# Altium schematic sheet SysUprTestUUUp.SchDoc (part 1 of 2) (continued)
## Parts (continued)
FU13  Predoxranitel  [MF-MSMF_1]  (value not drawn)
FU14  Predoxranitel  [MF-MSMF_1]  (value not drawn)
FU15  Predoxranitel  [MF-MSMF_1]  (value not drawn)
FU16  Predoxranitel  [MF-MSMF_1]  (value not drawn)
FU17  Predoxranitel  [MF-MSMF_1]  (value not drawn)
FU18  Predoxranitel  [MF-MSMF_1]  (value not drawn)
FU19  Predoxranitel  [MF-MSMF_1]  (value not drawn)
FU20  Predoxranitel  [MF-MSMF_1]  (value not drawn)
FU21  Predoxranitel  [MF-MSMF_1]  (value not drawn)
HL1  LED-RGB_C  [BL-L515]  (value not drawn)
KT1  Kont  [TESTPOINT]  (value not drawn)  (no BOM)
KT2  Kont  [TESTPOINT]  (value not drawn)  (no BOM)
KT3  Kont  [TESTPOINT]  (value not drawn)  (no BOM)
KT4  Kont  [TESTPOINT]  (value not drawn)  (no BOM)
KT5  Kont  [TESTPOINT]  (value not drawn)  (no BOM)
KT6  Kont  [TESTPOINT]  (value not drawn)  (no BOM)
KT7  Kont  [TESTPOINT]  (value not drawn)  (no BOM)
KT8  Kont  [TESTPOINT]  (value not drawn)  (no BOM)
KT9  Kont  [TESTPOINT]  (value not drawn)  (no BOM)
R1  value 1к  [Res0402]  (hidden comment: Resistor0062)
R2  value 1к  [Res0402]  (hidden comment: Resistor0062)
R3  value 1к  [Res0402]  (hidden comment: Resistor0062)
R4  value 1к  [Res0402]  (hidden comment: Resistor0062)
R5  value 1к  [Res0402]  (hidden comment: Resistor0062)
R6  value 1к  [Res0402]  (hidden comment: Resistor0062)
R7  value 10к  [Res0402]  (hidden comment: Resistor0062)
R8  value 10к  [Res0402]  (hidden comment: Resistor0062)
R9  value 10к  [Res0402]  (hidden comment: Resistor0062)
R10  value 10к  [Res0402]  (hidden comment: Resistor0062)
R11  value 10к  [Res0402]  (hidden comment: Resistor0062)
R12  value 10к  [Res0402]  (hidden comment: Resistor0062)
R13  value 10к  [Res0402]  (hidden comment: Resistor0062)
R14  value 10к  [Res0402]  (hidden comment: Resistor0062)
R15  value 10к  [Res0402]  (hidden comment: Resistor0062)
R16  value 10к  [Res0402]  (hidden comment: Resistor0062)
R17  value 10к  [Res0402]  (hidden comment: Resistor0062)
R18  value 10к  [Res0402]  (hidden comment: Resistor0062)
R19  value 10к  [Res0402]  (hidden comment: Resistor0062)
R20  value 100к  [Res0402]  (hidden comment: Resistor0062)
R21  value 100к  [Res0402]  (hidden comment: Resistor0062)
R22  value 1к  [Res0402]  (hidden comment: Resistor0062)
R23  value 1к  [Res0402]  (hidden comment: Resistor0062)
R24  value 1к  [Res0402]  (hidden comment: Resistor0062)
R25  value 1к  [Res0402]  (hidden comment: Resistor0062)
R26  value 1к  [Res0402]  (hidden comment: Resistor0062)
R27  value 1к  [Res0402]  (hidden comment: Resistor0062)
R28  value 10к  [Res0402]  (hidden comment: Resistor0062)
R29  value 10к  [Res0402]  (hidden comment: Resistor0062)
R30  value 100к  [Res0402]  (hidden comment: Resistor0062)
R31  value 100к  [Res0402]  (hidden comment: Resistor0062)
R32  value 100к  [Res0402]  (hidden comment: Resistor0062)
R33  value 100к  [Res0402]  (hidden comment: Resistor0062)
R34  value 100к  [Res0402]  (hidden comment: Resistor0062)
R35  value 100к  [Res0402]  (hidden comment: Resistor0062)
R36  value 100к  [Res0402]  (hidden comment: Resistor0062)
R37  value 100к  [Res0402]  (hidden comment: Resistor0062)
R38  value 1к  [Res0402]  (hidden comment: Resistor0062)
R39  value 1к  [Res0402]  (hidden comment: Resistor0062)
R40  value 1к  [Res0402]  (hidden comment: Resistor0062)
R41  value 100к  [Res0402]  (hidden comment: Resistor0062)
R42  value 100к  [Res0402]  (hidden comment: Resistor0062)
R43  value 100к  [Res0402]  (hidden comment: Resistor0062)
R44  value 100к  [Res0402]  (hidden comment: Resistor0062)
R45  value 100к  [Res0402]  (hidden comment: Resistor0062)
R46  value 100к  [Res0402]  (hidden comment: Resistor0062)
R47  value 100к  [Res0402]  (hidden comment: Resistor0062)
R48  value 100к  [Res0402]  (hidden comment: Resistor0062)
R49  value 10к  [Res0402]  (hidden comment: Resistor0062)
R50  value 10к  [Res0402]  (hidden comment: Resistor0062)
R51  value 100к  [Res0402]  (hidden comment: Resistor0062)
R52  value 100к  [Res0402]  (hidden comment: Resistor0062)
R53  value 100к  [Res0402]  (hidden comment: Resistor0062)
R54  value 100к  [Res0402]  (hidden comment: Resistor0062)
R55  value 100к  [Res0402]  (hidden comment: Resistor0062)
R56  value 100к  [Res0402]  (hidden comment: Resistor0062)
R57  value 100к  [Res0402]  (hidden comment: Resistor0062)
R58  value 100к  [Res0402]  (hidden comment: Resistor0062)
R59  value 120  [Res0805]  (hidden comment: Resistor0125)
R60  value 120  [Res0805]  (hidden comment: Resistor0125)
R61  value 120  [Res0805]  (hidden comment: Resistor0125)
R62  value 120  [Res0805]  (hidden comment: Resistor0125)
R63  value 120  [Res0805]  (hidden comment: Resistor0125)
R64  value 120  [Res0805]  (hidden comment: Resistor0125)
R65  value 120  [Res0805]  (hidden comment: Resistor0125)
R66  value 120  [Res0805]  (hidden comment: Resistor0125)
R67  value 10к  [Res0402]  (hidden comment: Resistor0062)
R68  value 10к  [Res0402]  (hidden comment: Resistor0062)
R69  value 10к  [Res0402]  (hidden comment: Resistor0062)
R70  value 10к  [Res0402]  (hidden comment: Resistor0062)
R71  value 10к  [Res0402]  (hidden comment: Resistor0062)
R72  value 10к  [Res0402]  (hidden comment: Resistor0062)
R73  value 10к  [Res0402]  (hidden comment: Resistor0062)
R74  value 10к  [Res0402]  (hidden comment: Resistor0062)
R75  value 10к  [Res0402]  (hidden comment: Resistor0062)
R76  value 10к  [Res0402]  (hidden comment: Resistor0062)
R77  value 10к  [Res0402]  (hidden comment: Resistor0062)
R78  value 10М  [Res0805]  (hidden comment: Resistor0125)
R79  value 10к  [Res0402]  (hidden comment: Resistor0062)
R80  value 10к  [Res0402]  (hidden comment: Resistor0062)
R81  value 10к  [Res0402]  (hidden comment: Resistor0062)
R82  value 10к  [Res0402]  (hidden comment: Resistor0062)
R83  value 10к  [Res0402]  (hidden comment: Resistor0062)
R84  value 10к  [Res0402]  (hidden comment: Resistor0062)
R85  value 10к  [Res0402]  (hidden comment: Resistor0062)
R86  value 10к  [Res0402]  (hidden comment: Resistor0062)
R87  value 10к  [Res0402]  (hidden comment: Resistor0062)
R88  value 10к  [Res0402]  (hidden comment: Resistor0062)
R89  value 10к  [Res0402]  (hidden comment: Resistor0062)
R90  value 10к  [Res0402]  (hidden comment: Resistor0062)
R91  value 10к  [Res0402]  (hidden comment: Resistor0062)
R92  value 6,8к  [Res0402]  (hidden comment: Resistor0062)
R93  value 6,8к  [Res0402]  (hidden comment: Resistor0062)
R94  value 1к  [Res0402]  (hidden comment: Resistor0062)
R95  value 3,3к  [Res0402]  (hidden comment: Resistor0062)
R96  value 3,3к  [Res0402]  (hidden comment: Resistor0062)
R97  value 10к  [Res0402]  (hidden comment: Resistor0062)
R98  value 10к  [Res0402]  (hidden comment: Resistor0062)
R99  value 1к  [Res0402]  (hidden comment: Resistor0062)
R100  value 1к  [Res0402]  (hidden comment: Resistor0062)
R101  value 10к  [Res0603]  (hidden comment: Resistor01)
R102  value 10к  [Res0402]  (hidden comment: Resistor0062)
R103  value 10к  [Res0402]  (hidden comment: Resistor0062)
R104  value 10к  [Res0402]  (hidden comment: Resistor0062)
R105  value 10к  [Res0402]  (hidden comment: Resistor0062)
R106  value 10к  [Res0402]  (hidden comment: Resistor0062)
R107  value 10к  [Res0402]  (hidden comment: Resistor0062)
R108  value 10к  [Res0402]  (hidden comment: Resistor0062)
R109  value 10к  [Res0402]  (hidden comment: Resistor0062)
R110  value 10к  [Res0402]  (hidden comment: Resistor0062)
R111  value 120  [Res0805]  (hidden comment: Resistor0125)
R112  value 120  [Res0805]  (hidden comment: Resistor0125)
R113  value 120  [Res0805]  (hidden comment: Resistor0125)
R114  value 120  [Res0805]  (hidden comment: Resistor0125)
R115  value 120  [Res0805]  (hidden comment: Resistor0125)
R116  value 120  [Res0805]  (hidden comment: Resistor0125)
R117  value 10к  [Res0402]  (hidden comment: Resistor0062)
R118  value 10к  [Res0402]  (hidden comment: Resistor0062)
R119  value 10к  [Res0402]  (hidden comment: Resistor0062)
R120  value 10к  [Res0402]  (hidden comment: Resistor0062)
R121  value 10к  [Res0402]  (hidden comment: Resistor0062)
R122  value 10к  [Res0402]  (hidden comment: Resistor0062)
R123  value 120  [Res0805]  (hidden comment: Resistor0125)
R124  value 10  [Res0603]  (hidden comment: Resistor01)
R125  value 120  [Res0805]  (hidden comment: Resistor0125)
R126  value 10  [Res0603]  (hidden comment: Resistor01)
R127  value 10  [Res0603]  (hidden comment: Resistor01)
R128  value 10  [Res0603]  (hidden comment: Resistor01)
R129  value 22  [Res0805]  (hidden comment: Resistor0125)
R130  value 22  [Res0805]  (hidden comment: Resistor0125)
R131  value 22  [Res0805]  (hidden comment: Resistor0125)
R132  value 22  [Res0805]  (hidden comment: Resistor0125)
R133  value 22  [Res0805]  (hidden comment: Resistor0125)
R134  value 22  [Res0805]  (hidden comment: Resistor0125)
R135  value 22  [Res0805]  (hidden comment: Resistor0125)
R136  value 22  [Res0805]  (hidden comment: Resistor0125)
R137  value 22  [Res0805]  (hidden comment: Resistor0125)
R138  value 22  [Res0805]  (hidden comment: Resistor0125)
R139  value 22  [Res0805]  (hidden comment: Resistor0125)
R140  value 22  [Res0805]  (hidden comment: Resistor0125)
R141  value 10к  [Res0402]  (hidden comment: Resistor0062)
R142  value 10к  [Res0402]  (hidden comment: Resistor0062)
R143  value 10к  [Res0402]  (hidden comment: Resistor0062)
R144  value 10к  [Res0402]  (hidden comment: Resistor0062)
R145  value 10к  [Res0402]  (hidden comment: Resistor0062)
R146  value 10к  [Res0402]  (hidden comment: Resistor0062)
VD1  Name: SMBJ5.0CA  [SMB_(DO-214AA) KA1-KA2]  (hidden comment: DiodZachitnuy)
VD2  Name: SMBJ5.0CA  [SMB_(DO-214AA) KA1-KA2]  (hidden comment: DiodZachitnuy)
VD3  Name: SMBJ5.0CA  [SMB_(DO-214AA) KA1-KA2]  (hidden comment: DiodZachitnuy)
VD4  Name: SMBJ5.0CA  [SMB_(DO-214AA) KA1-KA2]  (hidden comment: DiodZachitnuy)
VD5  Name: SMBJ5.0CA  [SMB_(DO-214AA) KA1-KA2]  (hidden comment: DiodZachitnuy)
VD6  Name: 2Д706АС9  [SOT23 2D706AS9]  (hidden comment: Diod2K)
VD7  DiodZachitnuy  [SMB_(DO-214AA) KA1-KA2]  (value not drawn)
VD8  DiodZachitnuy  [SMB_(DO-214AA) KA1-KA2]  (value not drawn)
VD9  DiodZachitnuy  [SMB_(DO-214AA) KA1-KA2]  (value not drawn)
VD10  DiodZachitnuy  [SMB_(DO-214AA) KA1-KA2]  (value not drawn)
VD11  DiodZachitnuy  [SMB_(DO-214AA) KA1-KA2]  (value not drawn)
VD12  DiodZachitnuy  [SMB_(DO-214AA) KA1-KA2]  (value not drawn)
VD13  Name: SMBJ5.0CA  [SMB_(DO-214AA) KA1-KA2]  (hidden comment: DiodZachitnuy)
VD14  Name: SMBJ5.0CA  [SMB_(DO-214AA) KA1-KA2]  (hidden comment: DiodZachitnuy)
VD15  Name: SMBJ5.0CA  [SMB_(DO-214AA) KA1-KA2]  (hidden comment: DiodZachitnuy)
VD16  Name: SMBJ5.0CA  [SMB_(DO-214AA) KA1-KA2]  (hidden comment: DiodZachitnuy)
XP1  ConnectorP34  [PLD-34]  (value not drawn)
XP2  ConnectorP10  [PLD-10]  (value not drawn)
XP3  ConnectorP4  [PLD-4]  (value not drawn)
XP4  ConnectorP8  [PLD-8]  (value not drawn)
XP5  ConnectorP2  [PLS-2]  (value not drawn)
XP6  ConnectorP2  [PLS-2]  (value not drawn)
XP7  ConnectorP8  [PLD-8]  (value not drawn)
XP8  ConnectorP2  [PLS-2]  (value not drawn)
XP9  ConnectorP3  [PLS-3]  (value not drawn)
XP10  ConnectorP4  [PLS-4]  (value not drawn)
XP11  ConnectorP40  [PLD-40R]  (value not drawn)
XP12  ConnectorP40  [PLD-40R]  (value not drawn)
XS1  ConnectorS40  [PBD-40]  (value not drawn)
XS2  ConnectorS40  [PBD-40]  (value not drawn)
ZQ1  value 8 МГц  [HC-49SM_U]  (hidden comment: Quartz)

## Nets
+3.3V_A: DD11.38(Vref+) DD11.39(Vdda) XS1.30 XS1.31
+3.3V_D: C1.2 C2.2 C4.2 C6.1 C7.2 C8.2 C15.2 C30.2 C31.2 C32.2 C39.2 C42.2 C43.2 C48.2 C55.2 C56.2 C57.2 C58.2 DA1.8(Vcc) DA2.8(Vcc) DA3.8(Vcc) DA4.8(Vcc) DA5.8(Vcc) DD11.15(Vdd) DD11.23(Vdd) DD11.36(Vdd) DD11.49(Vdd) DD11.62(Vdd) DD11.72(Vdd) DD11.82(Vdd) DD11.91(Vdd) DD11.103(Vdd) DD11.114(Vdd) DD11.127(Vdd) DD11.136(Vdd) DD11.149(Vdd) DD11.159(Vdd) DD11.172(Vdd) FU3.1 R2.2 R3.2 R4.2 R23.2 R24.2 R25.2 R26.2 R27.2 R28.1 R29.1 R49.2 R50.1 R79.1 R143.2 R144.2 R145.2 R146.2 VD5.KA1 VD6.A XP1.26 XP1.28 XP1.34 XP10.1 XS1.18 XS1.19
+5V_A: XS1.22 XS1.23
+5V_D: C3.2 C5.1 C9.2 C10.1 C11.2 C12.1 C13.2 C14.1 C16.2 C17.1 C18.2 C19.1 C20.2 C21.1 C22.2 C23.1 C33.1 C34.1 C35.1 C36.1 C37.1 C38.1 C40.2 C41.2 DD1.14(Vcc) DD2.14(Vcc) DD3.10(B3) DD3.13(B4) DD3.14(Vcc) DD4.2(B1) DD4.5(B2) DD4.10(B3) DD4.13(B4) DD4.14(Vcc) DD5.2(B1) DD5.5(B2) DD5.10(B3) DD5.13(B4) DD5.14(Vcc) DD6.2(B1) DD6.5(B2) DD6.10(B3) DD6.13(B4) DD6.14(Vcc) DD7.2(B1) DD7.5(B2) DD7.10(B3) DD7.13(B4) DD7.14(Vcc) DD8.10(MR) DD8.16(Vdd) DD9.10(MR) DD9.16(Vdd) DD10.10(MR) DD10.16(Vdd) DD12.8(Vcc) DD13.8(Vcc) DD14.8(Vcc) DD15.8(Vcc) DD16.8(Vcc) DD17.8(Vcc) DD18.8(Vcc) DD19.8(Vcc) R9.2 R10.2 R11.2 R12.2 R13.2 R14.2 R15.2 R16.2 R17.2 R80.1 R81.1 R82.1 R84.1 R85.1 R86.1 R87.1 R88.1 R89.1 R90.1 R91.1 R101.1 R102.2 R105.1 R106.1 R107.1 R108.1 R109.1 R110.1 R141.1 R142.1 XP2.4 XP2.7 XS1.10 XS1.11
+5V_PCB: XP11.36 XP11.39 XS1.34 XS1.35
+48V_IN: XP4.1 XP4.4 XP4.5 XP4.8 XS1.2 XS1.3 XS1.6 XS1.7
-5V_A: XS1.26 XS1.27
-5V_D: XS1.14 XS1.15
-5V_PCB: XP11.35 XP11.40 XS1.38 XS1.39
GND: C1.1 C2.1 C3.1 C4.1 C5.2 C6.2 C7.1 C8.1 C9.1 C10.2 C11.1 C12.2 C13.1 C14.2 C15.1 C16.1 C17.2 C18.1 C19.2 C20.1 C21.2 C22.1 C23.2 C24.1 C25.1 C26.1 C27.1 C28.1 C29.1 C30.1 C31.1 C32.1 C33.2 C34.2 C35.2 C36.2 C37.2 C38.2 C39.1 C40.1 C41.1 C42.1 C43.1 C44.1 C45.1 C46.1 C47.1 C48.1 C55.1 C56.1 C57.1 C58.1 DA1.4(GND) DA2.4(GND) DA3.4(GND) DA4.4(GND) DA5.4(GND) DD1.7(GND) DD2.7(GND) DD3.7(GND) DD4.7(GND) DD5.7(GND) DD6.7(GND) DD7.7(GND) DD8.8(GND) DD8.13(OE) DD9.8(GND) DD9.13(OE) DD10.8(GND) DD10.13(OE) DD11.14(Vss) DD11.22(Vss) DD11.48(BYPASS_REG) DD11.61(Vss) DD11.71(Vss) DD11.90(Vss) DD11.102(Vss) DD11.113(Vss) DD11.126(Vss) DD11.135(Vss) DD11.148(Vss) DD11.158(Vss) DD12.5(GND) DD13.5(GND) DD14.5(GND) DD15.5(GND) DD16.5(GND) DD17.5(GND) DD18.5(GND) DD19.5(GND) HL1.3(A) R1.2 R5.2 R6.2 R7.2 R8.2 R18.2 R19.2 R20.2 R21.2 R22.2 R30.2 R31.2 R32.2 R33.2 R34.2 R35.2 R36.2 R37.2 R38.2 R39.2 R40.2 R41.2 R42.2 R43.2 R44.2 R45.2 R46.2 R47.2 R48.2 R75.1 R76.1 R77.1 R83.1 R92.1 R93.1 R97.1 R98.1 R103.2 R104.2 R117.1 R118.1 R119.1 R120.1 R121.1 R122.1 VD1.KA1 VD2.KA1 VD3.KA1 VD4.KA1 VD5.KA2 VD13.KA1 VD14.KA1 VD15.KA1 VD16.KA1 XP1.1 XP1.25 XP1.33 XP2.5 XP2.6 XP5.2 XP6.2 XP7.2 XP7.7 XP8.2 XP9.3 XP10.4 XS1.9 XS1.12 XS1.13 XS1.16 XS1.17 XS1.20
GND_IN: XP4.2 XP4.3 XP4.6 XP4.7 XS1.1 XS1.4 XS1.5 XS1.8
GND_PCB: XP11.37 XP11.38 XS1.33 XS1.36 XS1.37 XS1.40
GNDA: DD11.37(Vssa) R67.2 R68.2 R69.2 R70.2 R71.2 R72.2 R73.2 R74.2 XS1.21 XS1.24 XS1.25 XS1.28 XS1.29 XS1.32
ADDR1: DD2.1(A1) DD11.176(PI7) R12.1
ADDR1_PCB: DD2.2(~{Y1}) XP12.11
ADDR2: DD2.3(A2) DD11.175(PI6) R13.1
ADDR2_PCB: DD2.4(~{Y2}) XP12.12
ADDR3: DD2.5(A3) DD11.174(PI5) R14.1
ADDR3_PCB: DD2.6(~{Y3}) XP12.13
ADDR4: DD2.9(A4) DD11.173(PI4) R15.1
ADDR4_PCB: DD2.8(~{Y4}) XP12.14
ADDR5: DD2.11(A5) DD11.170(PE1) R16.1
ADDR5_PCB: DD2.10(~{Y5}) XP12.15
ADDR6: DD2.13(A6) DD11.169(PE0) R17.1
ADDR6_PCB: DD2.12(~{Y6}) XP12.16
BOOT0: DD11.166(BOOT0) R49.1 XP5.1
CH1_EN: DD11.130(PH15) KT3.1
CH2_EN: DD11.129(PH14) KT4.1
CH3_EN: DD11.128(PH13) KT5.1
CH4_EN: DD11.89(PH12) KT6.1
CH5_EN: DD11.88(PH11) KT7.1
CH6_EN: DD11.87(PH10) KT8.1
CH7_EN: DD11.86(PH9) KT9.1
DS_MISO: DD11.1(PE2) XS2.33
DS_MOSI: DD11.2(PE3) XS2.34
I2C_SCL: DA5.2(SCL) DD11.84(PH7) R29.2
I2C_SDA: DA5.1(SDA) DD11.85(PH8) R28.2
INT1_CP: DD4.3(Y1) DD11.160(PG15)
INT1_PCB: DD4.1(A1) R30.1 XP12.26
INT2_CP: DD4.6(Y2) DD11.156(PG13)
INT2_PCB: DD4.4(A2) R31.1 XP12.27
INT3_CP: DD4.8(Y3) DD11.155(PG12)
INT3_PCB: DD4.9(A3) R32.1 XP12.28
INT4_CP: DD4.11(Y4) DD11.154(PG11)
INT4_PCB: DD4.12(A4) R33.1 XP12.29
INT5_CP: DD5.3(Y1) DD11.153(PG10)
INT5_PCB: DD5.1(A1) R34.1 XP12.30
INT6_CP: DD5.6(Y2) DD11.152(PG9)
INT6_PCB: DD5.4(A2) R35.1 XP12.31
INT7_CP: DD5.8(Y3) DD11.112(PG8)
INT7_PCB: DD5.9(A3) R36.1 XP12.32
INT8_CP: DD5.11(Y4) DD11.111(PG7)
INT8_PCB: DD5.12(A4) R37.1 XP12.33
LCD_CS: DD11.157(PG14) XP1.20
LCD_D0: DD11.104(PD14) XP1.4
LCD_D1: DD11.105(PD15) XP1.3
LCD_D2: DD11.142(PD0) XP1.6
LCD_D3: DD11.143(PD1) XP1.5
LCD_D4: DD11.68(PE7) XP1.8
LCD_D5: DD11.69(PE8) XP1.7
LCD_D6: DD11.70(PE9) XP1.10
LCD_D7: DD11.73(PE10) XP1.9
LCD_D8: DD11.74(PE11) XP1.12
LCD_D9: DD11.75(PE12) XP1.11
LCD_D10: DD11.76(PE13) XP1.14
LCD_D11: DD11.77(PE14) XP1.13
LCD_D12: DD11.78(PE15) XP1.16
LCD_D13: DD11.96(PD8) XP1.15
LCD_D14: DD11.97(PD9) XP1.18
LCD_D15: DD11.98(PD10) XP1.17
LCD_RD: DD11.146(PD4) XP1.21
LCD_RS: DD11.109(PG5) XP1.19
LCD_WR: DD11.147(PD5) XP1.22
LED1_CP: DD6.8(Y3) DD11.10(PC15)
LED1_PCB: DD6.9(A3) R43.1 XP12.17
LED2_CP: DD6.11(Y4) DD11.11(PI9)
LED2_PCB: DD6.12(A4) R44.1 XP12.18
LED3_CP: DD7.3(Y1) DD11.12(PI10)
LED3_PCB: DD7.1(A1) R45.1 XP12.19
LED4_CP: DD7.6(Y2) DD11.13(PI11)
LED4_PCB: DD7.4(A2) R46.1 XP12.20
LED5_CP: DD7.8(Y3) DD11.16(PF0)
LED5_PCB: DD7.9(A3) R47.1 XP12.21
LED6_CP: DD7.11(Y4) DD11.17(PF1)
LED6_PCB: DD7.12(A4) R48.1 XP12.22
LED_DEBUG_B_CP: DD1.5(A3) DD11.44(PH3)
LED_DEBUG_G_CP: DD1.3(A2) DD11.43(PH2)
LED_DEBUG_O_B: DD1.6(~{Y3}) R100.1
LED_DEBUG_O_G: DD1.4(~{Y2}) R99.1
LED_DEBUG_O_R: DD1.2(~{Y1}) R94.1
LED_DEBUG_R_CP: DD1.1(A1) DD11.7(PI8)
LED_DS_CP: DD1.13(A6) DD11.131(PI0) R11.1
LED_DS_O: DD1.12(~{Y6}) XP2.3 XP2.8
LED_SHCP_CP: DD1.11(A5) DD11.132(PI1) R10.1
LED_SHCP_O: DD1.10(~{Y5}) XP2.2 XP2.9
LED_STCP_CP: DD1.9(A4) DD11.133(PI2) R9.1
LED_STCP_O: DD1.8(~{Y4}) XP2.1 XP2.10
NRST: DD11.31(NRST) R50.2 XP1.24 XP6.1
OTG_FS_DM: DD11.122(PA11) XS2.40
OTG_FS_DP: DD11.123(PA12) XS2.37
OTG_FS_ID: DD11.121(PA10) XS2.39
PDR_ON: DD11.171(PDR_ON) R79.2 XP8.1
RCC_OSC_IN: C24.2 DD11.29(PH0) R78.2 ZQ1.2
RCC_OSC_OUT: C25.2 DD11.30(PH1) R78.1 ZQ1.1
RS485_A_PC: FU7.2 XP3.1 XP3.4
RS485_A_PCB: FU6.2 XP11.21
RS485_B_PC: FU21.2 XP3.2 XP3.3
RS485_B_PCB: FU20.2 XP11.22
RS485_DI: DD11.42(PA2) DD18.4(DI) R101.2
RS485_DI_PC: DD11.79(PB10) DD19.4(DI) R102.1
RS485_EN: DD11.119(PA8) DD18.2(~{RE}) DD18.3(DE) R97.2
RS485_EN_PC: DD11.92(PB12) DD19.2(~{RE}) DD19.3(DE) R98.2
RS485_RO: DD11.47(PA3) R92.2 R95.1
RS485_RO_PC: DD11.80(PB11) R93.2 R96.1
SDIO: DD11.124(PA13) FU4.1 R144.1 VD4.KA2 XP10.3
SHCP_CLK: DD11.3(PE4) XS2.36
SPI1_CLK: DD11.161(PB3) DD14.4(DI)
SPI1_MISO: DD11.162(PB4) DD13.1(RO)
SPI1_MOSI: DD11.163(PB5) DD12.4(DI)
SPI1_SS: DD11.50(PA4) DD15.4(DI)
SPI_CLK_PCB+: FU12.2 XP11.5
SPI_CLK_PCB-: FU13.2 XP11.6
SPI_MISO_PCB+: FU10.2 XP11.3
SPI_MISO_PCB-: FU11.2 XP11.4
SPI_MOSI_PCB+: FU8.2 XP11.1
SPI_MOSI_PCB-: FU9.2 XP11.2
SPI_SS_PCB+: FU14.2 XP11.7
SPI_SS_PCB-: FU15.2 XP11.8
SR0_CP: DD8.15(Q0) DD11.168(PB9)
SR1_CP: DD8.1(Q1) DD11.167(PB8)
SR2_CP: DD8.2(Q2) DD11.164(PB6)
SR3_CP: DD8.3(Q3) DD11.151(PD7)
SR4_CP: DD8.4(Q4) DD11.150(PD6)
SR5_CP: DD8.5(Q5) DD11.145(PD3)
SR6_CP: DD8.6(Q6) DD11.144(PD2)
SR7_CP: DD8.7(Q7) DD11.141(PC12)
SR8_CP: DD9.15(Q0) DD11.140(PC11)
SR9_CP: DD9.1(Q1) DD11.139(PC10)
SR10_CP: DD9.2(Q2) DD11.134(PI3)
SR11_CP: DD9.3(Q3) DD11.118(PС9)
SR12_CP: DD9.4(Q4) DD11.117(PС8)
SR13_CP: DD9.5(Q5) DD11.116(PС7)
SR14_CP: DD9.6(Q6) DD11.115(PС6)
SR15_CP: DD9.7(Q7) DD11.110(PG6)
SR16_CP: DD10.15(Q0) DD11.108(PG4)
SR17_CP: DD10.1(Q1) DD11.107(PG3)
SR18_CP: DD10.2(Q2) DD11.106(PG2)
SR19_CP: DD10.3(Q3) DD11.101(PD13)
SR20_CP: DD10.4(Q4) DD11.100(PD12)
SR21_CP: DD10.5(Q5) DD11.99(PD11)
SR22_CP: DD10.6(Q6) DD11.83(PH6)
SR23_CP: DD10.7(Q7) DD11.65(PF15)
SR_DS_PCB: DD8.14(DS) R75.2 XP12.23
SR_SHCP_PCB: DD8.11(SHCP) DD9.11(SHCP) DD10.11(SHCP) R76.2 XP12.25
SR_STCP_PCB: DD8.12(STCP) DD9.12(STCP) DD10.12(STCP) R77.2 XP12.24
STCP_CS1: DD11.4(PE5) XS2.35
STCP_CS2: DD11.5(PE6) XS2.38
SVBP1_CP: DD6.3(Y1) DD11.8(PC13)
SVBP1_PCB: DD6.1(A1) R41.1 XP11.23
SVBP2_CP: DD6.6(Y2) DD11.9(PC14)
SVBP2_PCB: DD6.4(A2) R42.1 XP11.24
SWCLK: DD11.137(PA14) FU5.1 R146.1 VD3.KA2 XP10.2
TP_CS: DD11.54(PC4) XP1.30
TP_IRQ: DD11.55(PC5) XP1.27
TP_MISO: DD11.94(PB14) XP1.31
TP_MOSI: DD11.95(PB15) XP1.32
TP_SCK: DD11.93(PB13) XP1.29
TRM_SCL_PCB: FU2.2 XP12.10
TRM_SDA_PCB: FU1.2 XP12.9
UART6_RX: DD11.57(PB1) XP11.9
UART6_TX: DD11.56(PB0) XP11.10
UIM_EN1_CP: DD3.2(B1) DD11.63(PF13) R18.1
UIM_EN2_CP: DD3.5(B2) DD11.64(PF14) R19.1
UIM_IN1_CP: DD3.8(Y3) DD11.52(PA6) DD11.66(PG0)
UIM_IN1_PCB: DD3.9(A3) R20.1 XP11.19
UIM_IN2_CP: DD3.11(Y4) DD11.53(PA7) DD11.67(PG1)
UIM_IN2_PCB: DD3.12(A4) R21.1 XP11.20
UIM_OUT1_CP: DD3.1(A1) DD11.40(PA0) R7.1 R59.1 R60.1 R61.1 R62.1 R63.1 R64.1 R65.1 R66.1
UIM_OUT1_PCB: DD3.3(Y1) DD16.4(DI) XP11.15
UIM_OUT1_PCB+: FU16.2 XP11.13
UIM_OUT1_PCB-: FU17.2 XP11.14
UIM_OUT2_CP: DD3.4(A2) DD11.138(PA15) R8.1
UIM_OUT2_PCB: DD3.6(Y2) DD17.4(DI) XP11.18
UIM_OUT2_PCB+: FU18.2 XP11.16
UIM_OUT2_PCB-: FU19.2 XP11.17
USART1_RX: DD11.165(PB7) R143.1 XP9.2
USART1_TX: DD11.120(PA9) R145.1 XP9.1
VBAT: C28.2 C29.2 DD11.6(Vbat) VD6.K1 VD6.K2
VCAP_1: C26.2 DD11.81(Vcap_1)
VCAP_2: C27.2 DD11.125(Vcap_2)
VOLT1_ADC: DD11.19(PF3) R51.2 R67.1
VOLT1_EN: DD11.46(PH5) XS2.1
VOLT1_PCB: R51.1 XP12.1 XS2.4
VOLT1_UIM: R59.2 XS2.2
VOLT2_ADC: DD11.20(PF4) R52.2 R68.1
VOLT2_EN: DD11.45(PH4) XS2.6
VOLT2_PCB: R52.1 XP12.2 XS2.5
VOLT2_UIM: R60.2 XS2.3
VOLT3_ADC: DD11.21(PF5) R53.2 R69.1
VOLT3_EN: DD11.41(PA1) XS2.7
VOLT3_PCB: R53.1 XP12.3 XS2.10
VOLT3_UIM: R61.2 XS2.8
VOLT4_ADC: DD11.24(PF6) R54.2 R70.1
VOLT4_EN: DD11.35(PC3) XS2.12
VOLT4_PCB: R54.1 XP12.4 XS2.11
VOLT4_UIM: R62.2 XS2.9
VOLT5_ADC: DD11.25(PF7) R55.2 R71.1
VOLT5_EN: DD11.34(PC2) XS2.13
VOLT5_PCB: R55.1 XP12.5 XS2.16
VOLT5_UIM: R63.2 XS2.14
VOLT6_ADC: DD11.26(PF8) R56.2 R72.1
VOLT6_EN: DD11.33(PC1) XS2.18
VOLT6_PCB: R56.1 XP12.6 XS2.17
VOLT6_UIM: R64.2 XS2.15
VOLT7_ADC: DD11.27(PF9) R57.2 R73.1
VOLT7_EN: DD11.32(PC0) XS2.19
VOLT7_PCB: R57.1 XP12.7 XS2.22
VOLT7_UIM: R65.2 XS2.20
VOLT8_ADC: DD11.28(PF10) R58.2 R74.1
VOLT8_EN: DD11.18(PF2) XS2.24
VOLT8_PCB: R58.1 XP12.8 XS2.23
VOLT8_UIM: R66.2 XS2.21
NetC44_2: C44.2 FU6.1 R127.1 VD13.KA2
NetC45_2: C45.2 FU7.1 R128.1 VD14.KA2
NetC46_2: C46.2 FU20.1 R124.1 VD15.KA2
NetC47_2: C47.2 FU21.1 R126.1 VD16.KA2
NetC49_1: C49.1 FU9.1 R130.2 VD7.KA1
NetC49_2: C49.2 FU8.1 R129.2 VD7.KA2
NetC50_1: C50.1 FU11.1 R132.2 VD8.KA1
NetC50_2: C50.2 FU10.1 R131.2 VD8.KA2
NetC51_1: C51.1 FU13.1 R134.2 VD9.KA1
NetC51_2: C51.2 FU12.1 R133.2 VD9.KA2
NetC52_1: C52.1 FU15.1 R136.2 VD10.KA1
NetC52_2: C52.2 FU14.1 R135.2 VD10.KA2
NetC53_1: C53.1 FU17.1 R138.2 VD11.KA1
NetC53_2: C53.2 FU16.1 R137.2 VD11.KA2
NetC54_1: C54.1 FU19.1 R140.2 VD12.KA1
NetC54_2: C54.2 FU18.1 R139.2 VD12.KA2
NetDA1_1: DA1.1(SDA) DA2.1(SDA) DA3.1(SDA) DA4.1(SDA) FU1.1 VD1.KA2
NetDA1_2: DA1.2(SCL) DA2.2(SCL) DA3.2(SCL) DA4.2(SCL) FU2.1 VD2.KA2
NetDA1_5: DA1.5(A2) R2.1
NetDA1_6: DA1.6(A1) R5.1
NetDA1_7: DA1.7(A0) R1.1
NetDA2_5: DA2.5(A2) R4.1
NetDA2_6: DA2.6(A1) R6.1
NetDA2_7: DA2.7(A0) R3.1
NetDA3_5: DA3.5(A2) R23.1
NetDA3_6: DA3.6(A1) R26.1
NetDA3_7: DA3.7(A0) R22.1
NetDA4_5: DA4.5(A2) R25.1
NetDA4_6: DA4.6(A1) R27.1
NetDA4_7: DA4.7(A0) R24.1
NetDA5_5: DA5.5(A2) R39.1
NetDA5_6: DA5.6(A1) R40.1
NetDA5_7: DA5.7(A0) R38.1
NetDD8_9: DD8.9(Q7S) DD9.14(DS)
NetDD9_9: DD9.9(Q7S) DD10.14(DS)
NetDD12_1: DD12.1(RO) R80.2
NetDD12_2: DD12.2(~{RE}) DD12.3(DE) R81.2
NetDD12_6: DD12.6(A/Y) R105.2 R111.2 R129.1
NetDD12_7: DD12.7(~{B}/~{Z}) R111.1 R117.2 R130.1
NetDD13_2: DD13.2(~{RE}) DD13.3(DE) R83.2
NetDD13_4: DD13.4(DI) R82.2
NetDD13_6: DD13.6(A/Y) R106.2 R112.2 R131.1
NetDD13_7: DD13.7(~{B}/~{Z}) R112.1 R118.2 R132.1
NetDD14_1: DD14.1(RO) R84.2
NetDD14_2: DD14.2(~{RE}) DD14.3(DE) R85.2
NetDD14_6: DD14.6(A/Y) R107.2 R113.2 R133.1
NetDD14_7: DD14.7(~{B}/~{Z}) R113.1 R119.2 R134.1
NetDD15_1: DD15.1(RO) R86.2
NetDD15_2: DD15.2(~{RE}) DD15.3(DE) R87.2
NetDD15_6: DD15.6(A/Y) R108.2 R114.2 R135.1
NetDD15_7: DD15.7(~{B}/~{Z}) R114.1 R120.2 R136.1
NetDD16_1: DD16.1(RO) R88.2
NetDD16_2: DD16.2(~{RE}) DD16.3(DE) R89.2
NetDD16_6: DD16.6(A/Y) R109.2 R115.2 R137.1
NetDD16_7: DD16.7(~{B}/~{Z}) R115.1 R121.2 R138.1
NetDD17_1: DD17.1(RO) R90.2
NetDD17_2: DD17.2(~{RE}) DD17.3(DE) R91.2
NetDD17_6: DD17.6(A/Y) R110.2 R116.2 R139.1
NetDD17_7: DD17.7(~{B}/~{Z}) R116.1 R122.2 R140.1
NetDD18_1: DD18.1(RO) R95.2
NetDD18_6: DD18.6(A/Y) R123.1 R127.2 R141.2
NetDD18_7: DD18.7(~{B}/~{Z}) R103.1 R123.2 R124.2
NetDD19_1: DD19.1(RO) R96.2
NetDD19_6: DD19.6(A/Y) R125.1 R128.2 R142.2
NetDD19_7: DD19.7(~{B}/~{Z}) R104.1 R125.2 R126.2
NetFU3_2: FU3.2 XP7.1 XP7.8
NetFU4_2: FU4.2 XP7.4 XP7.5
NetFU5_2: FU5.2 XP7.3 XP7.6
NetHL1_1: HL1.1(G) R99.2
NetHL1_2: HL1.2(B) R94.2
NetHL1_4: HL1.4(R) R100.2
NetKT1_1: KT1.1 XP1.2
NetKT2_1: KT2.1 XP1.23

Not connected (* = marked no-connect by the designer): DA1 3(OS); DA2 3(OS); DA3 3(OS); DA4 3(OS); DA5 3(OS); DD10 9(Q7S); DD11 51(PA5) 58(PB2) 59(PF11) 60(PF12); XP11 11 12 25 26 27 28 29 30 31 32 33 34; XP12 34 35 36 37 38 39 40; XS2 25 26 27 28 29 30 31 32

## Notes on the sheet
- "PCB LEFT"
- (near XP1) "LCD  ILI9325"
- 66
- 86
- 99
- 107
- 115
- 124
- 132
- 133
- 27
- 28
- 72
- 73
- 184
- 194
- 35
- 67
- 87
- 134
- 135
- 136
- 166
- 29
- 30
- 32
- 74
- 75
- 195
- 196
- 197
- 36
- 37
- 68
- 88
- 100
- 108
- 116
- 125
- 137
- 138
- 167
- (near R77) 168
- (near R77) 124
- 169
- 182
- 76
- 77
- 198
- 199
- 200
- 38
- 39
- 40
- 139
- (near R77) 125
- (near R77) 126
- 185
- 201
- 208
- 41
- 42
- 69
- 61
- 101
- 109
- 117
- 126
- 140
- 141
- 128
- (near R77) 127
- 129
- 123
- 183
- 209
- 44
- 45
- 43
- 70
- 62
- 142
- 143
- 144
- 186
- 202
- 203
- 46
- 47
- 71
- 63
- 102
- 110
- 118
- 127
- 145
- 146
- 26
- 130
- 131
- 204
- 205
- 95
- 48
- 49
- 50
- 147
- 156
- 157
- 52
- 82
- 96
- 51
- 148
- 149
- 158
- 174
- 83
- 206
- 207
- 53
- 54
- 89
- 150
- 151
- 152
- 159
- 160
- 112
- 111
- 55
- 90
- 103
- 119
- 153
- 154
- 161
- 162
- 163
- 56
- 155
- 170
- 171
- 57
- 58
- 91
- 104
- 120
- 20
- 21
- 59
- 60
- 92
- 6
- 7
- 14
- 15
- 93
- 105
- 113
- 121
- 12
- 94
- 13
- 9
- 78
- 164
- 80
- "LEDS"
- 106
- 114
- 122
- 18
- 19
- 172
- 24
- 3
- 8
- 4
- 5
- 25
- 173
- 187
- 188
- 191
- "PCB RIGHT"
- 79
- 189
- 10
- 97
- 98
- 165
- 181
- 11
- 81
- 33
- 34
- 31
- "RS485_PC"
- 16
- 190
- 64
- 1
- 2
- 17
- 65
- (near R8) 82
- 22
- 175
- 176
- 192
- 23
- (near XP4) "+48В"
- "DEBUG"
- 168
- "SWD"
- 177
- "PDR_ON"
- 85
- 84
- 178
- 179
- 180
- 193
- "BOOT0"
- "RESET"
- Перв. примен.
- Справ. №
- Подп. и дата
- Инв. № дубл.
- Взам. инв. №
- Изм.
- Лист
- № докум.
- Подп.
- Дата
- Лит.
- Масса
- Масштаб
- Пров.
- Разраб.
- Листов
- Инв. № подл.
- Н.контр.
- Утв.
- Копировал:
- Формат А1
- (in symbol 2) Конт.; Цепь
- (in symbol 3) Цепь; Конт.
- (in symbol 4) Цепь; Конт.
- (in symbol 40) PG
- (in symbol 42) Цепь; Конт.
- (in symbol 44) Цепь; Конт.
- (in symbol 45) Цепь; Конт.
- (in symbol 57) Цепь; Конт.
- (in symbol 72, part A) &
- (in symbol 72, part B) &
- (in symbol 72, part C) &
- (in symbol 72, part D) &
- (in symbol 78) A
- (in symbol 109) DD
- (in symbol 120) Цепь; Конт.
- (in symbol 338) Конт.; Цепь